# Altium schematic sheet WordClock2.SchDoc (continued)
## Parts (continued)
C240  GRM188R71H104KA93D  [CAPC1608X90X35ML10T15]  (value not drawn)
C241  GRM188R71H104KA93D  [CAPC1608X90X35ML10T15]  (value not drawn)
C242  GRM188R71H104KA93D  [CAPC1608X90X35ML10T15]  (value not drawn)
C243  GRM188R71H104KA93D  [CAPC1608X90X35ML10T15]  (value not drawn)
C244  GRM188R71H104KA93D  [CAPC1608X90X35ML10T15]  (value not drawn)
C245  GRM188R71H104KA93D  [CAPC1608X90X35ML10T15]  (value not drawn)
C246  GRM188R71H104KA93D  [CAPC1608X90X35ML10T15]  (value not drawn)
C247  GRM188R71H104KA93D  [CAPC1608X90X35ML10T15]  (value not drawn)
C248  GRM188R71H104KA93D  [CAPC1608X90X35ML10T15]  (value not drawn)
C249  GRM188R71H104KA93D  [CAPC1608X90X35ML10T15]  (value not drawn)
C250  GRM188R71H104KA93D  [CAPC1608X90X35ML10T15]  (value not drawn)
C251  GRM188R71H104KA93D  [CAPC1608X90X35ML10T15]  (value not drawn)
C252  GRM188R71H104KA93D  [CAPC1608X90X35ML10T15]  (value not drawn)
C253  GRM188R71H104KA93D  [CAPC1608X90X35ML10T15]  (value not drawn)
C254  GRM188R71H104KA93D  [CAPC1608X90X35ML10T15]  (value not drawn)
C255  GRM188R71H104KA93D  [CAPC1608X90X35ML10T15]  (value not drawn)
C256  GRM188R71H104KA93D  [CAPC1608X90X35ML10T15]  (value not drawn)
C257  CL05A226MQ5QUNC  [FP-CL746-IPC_C]
C258  CL05A226MQ5QUNC  [FP-CL746-IPC_C]
E1  1760490000  [PM_5_08_90_02]
J1  USB4110-GF-A  [FP-USB4110-GF-A-MFG]
J2  TC2030-IDC-NL  [TAG_TC2030-IDC-NL]
R1  CRCW060310K0FKEA  [RESC1609X50X30NL8T20]
R2  CRCW06035K10FKEA  [FP-CRCW0603-e3-IPC_C]
R3  CRCW06035K10FKEA  [FP-CRCW0603-e3-IPC_C]
SW1  147873-1  [FP-147873-1-MFG]
U1  1655  [ADA-RGB-1655_V]
U2  1655  [ADA-RGB-1655_V]
U3  1655  [ADA-RGB-1655_V]
U4  1655  [ADA-RGB-1655_V]
U5  1655  [ADA-RGB-1655_V]
U6  1655  [ADA-RGB-1655_V]
U7  1655  [ADA-RGB-1655_V]
U8  1655  [ADA-RGB-1655_V]
U9  1655  [ADA-RGB-1655_V]
U10  1655  [ADA-RGB-1655_V]
U11  1655  [ADA-RGB-1655_V]
U12  1655  [ADA-RGB-1655_V]
U13  1655  [ADA-RGB-1655_V]
U14  1655  [ADA-RGB-1655_V]
U15  1655  [ADA-RGB-1655_V]
U16  1655  [ADA-RGB-1655_V]
U17  1655  [ADA-RGB-1655_V]
U18  1655  [ADA-RGB-1655_V]
U19  1655  [ADA-RGB-1655_V]
U20  1655  [ADA-RGB-1655_V]
U21  1655  [ADA-RGB-1655_V]
U22  1655  [ADA-RGB-1655_V]
U23  1655  [ADA-RGB-1655_V]
U24  1655  [ADA-RGB-1655_V]
U25  1655  [ADA-RGB-1655_V]
U26  1655  [ADA-RGB-1655_V]
U27  1655  [ADA-RGB-1655_V]
U28  1655  [ADA-RGB-1655_V]
U29  1655  [ADA-RGB-1655_V]
U30  1655  [ADA-RGB-1655_V]
U31  1655  [ADA-RGB-1655_V]
U32  1655  [ADA-RGB-1655_V]
U33  1655  [ADA-RGB-1655_V]
U34  1655  [ADA-RGB-1655_V]
U35  1655  [ADA-RGB-1655_V]
U36  1655  [ADA-RGB-1655_V]
U37  1655  [ADA-RGB-1655_V]
U38  1655  [ADA-RGB-1655_V]
U39  1655  [ADA-RGB-1655_V]
U40  1655  [ADA-RGB-1655_V]
U41  1655  [ADA-RGB-1655_V]
U42  1655  [ADA-RGB-1655_V]
U43  1655  [ADA-RGB-1655_V]
U44  1655  [ADA-RGB-1655_V]
U45  1655  [ADA-RGB-1655_V]
U46  1655  [ADA-RGB-1655_V]
U47  1655  [ADA-RGB-1655_V]
U48  1655  [ADA-RGB-1655_V]
U49  1655  [ADA-RGB-1655_V]
U50  1655  [ADA-RGB-1655_V]
U51  1655  [ADA-RGB-1655_V]
U52  1655  [ADA-RGB-1655_V]
U53  1655  [ADA-RGB-1655_V]
U54  1655  [ADA-RGB-1655_V]
U55  1655  [ADA-RGB-1655_V]
U56  1655  [ADA-RGB-1655_V]
U57  1655  [ADA-RGB-1655_V]
U58  1655  [ADA-RGB-1655_V]
U59  1655  [ADA-RGB-1655_V]
U60  1655  [ADA-RGB-1655_V]
U61  1655  [ADA-RGB-1655_V]
U62  1655  [ADA-RGB-1655_V]
U63  1655  [ADA-RGB-1655_V]
U64  1655  [ADA-RGB-1655_V]
U65  1655  [ADA-RGB-1655_V]
U66  1655  [ADA-RGB-1655_V]
U67  1655  [ADA-RGB-1655_V]
U68  1655  [ADA-RGB-1655_V]
U69  1655  [ADA-RGB-1655_V]
U70  1655  [ADA-RGB-1655_V]
U71  1655  [ADA-RGB-1655_V]
U72  1655  [ADA-RGB-1655_V]
U73  1655  [ADA-RGB-1655_V]
U74  1655  [ADA-RGB-1655_V]
U75  1655  [ADA-RGB-1655_V]
U76  1655  [ADA-RGB-1655_V]
U77  1655  [ADA-RGB-1655_V]
U78  1655  [ADA-RGB-1655_V]
U79  1655  [ADA-RGB-1655_V]
U80  1655  [ADA-RGB-1655_V]
U81  1655  [ADA-RGB-1655_V]
U82  1655  [ADA-RGB-1655_V]
U83  1655  [ADA-RGB-1655_V]
U84  1655  [ADA-RGB-1655_V]
U85  1655  [ADA-RGB-1655_V]
U86  1655  [ADA-RGB-1655_V]
U87  1655  [ADA-RGB-1655_V]
U88  1655  [ADA-RGB-1655_V]
U89  1655  [ADA-RGB-1655_V]
U90  1655  [ADA-RGB-1655_V]
U91  1655  [ADA-RGB-1655_V]
U92  1655  [ADA-RGB-1655_V]
U93  1655  [ADA-RGB-1655_V]
U94  1655  [ADA-RGB-1655_V]
U95  1655  [ADA-RGB-1655_V]
U96  1655  [ADA-RGB-1655_V]
U97  1655  [ADA-RGB-1655_V]
U98  1655  [ADA-RGB-1655_V]
U99  1655  [ADA-RGB-1655_V]
U100  1655  [ADA-RGB-1655_V]
U101  1655  [ADA-RGB-1655_V]
U102  1655  [ADA-RGB-1655_V]
U103  1655  [ADA-RGB-1655_V]
U104  1655  [ADA-RGB-1655_V]
U105  1655  [ADA-RGB-1655_V]
U106  1655  [ADA-RGB-1655_V]
U107  1655  [ADA-RGB-1655_V]
U108  1655  [ADA-RGB-1655_V]
U109  1655  [ADA-RGB-1655_V]
U110  1655  [ADA-RGB-1655_V]
U111  1655  [ADA-RGB-1655_V]
U112  1655  [ADA-RGB-1655_V]
U113  1655  [ADA-RGB-1655_V]
U114  1655  [ADA-RGB-1655_V]
U115  1655  [ADA-RGB-1655_V]
U116  1655  [ADA-RGB-1655_V]
U117  1655  [ADA-RGB-1655_V]
U118  1655  [ADA-RGB-1655_V]
U119  1655  [ADA-RGB-1655_V]
U120  1655  [ADA-RGB-1655_V]
U121  1655  [ADA-RGB-1655_V]
U122  1655  [ADA-RGB-1655_V]
U123  1655  [ADA-RGB-1655_V]
U124  1655  [ADA-RGB-1655_V]
U125  1655  [ADA-RGB-1655_V]
U126  1655  [ADA-RGB-1655_V]
U127  1655  [ADA-RGB-1655_V]
U128  1655  [ADA-RGB-1655_V]
U129  1655  [ADA-RGB-1655_V]
U130  1655  [ADA-RGB-1655_V]
U131  1655  [ADA-RGB-1655_V]
U132  1655  [ADA-RGB-1655_V]
U133  1655  [ADA-RGB-1655_V]
U134  1655  [ADA-RGB-1655_V]
U135  1655  [ADA-RGB-1655_V]
U136  1655  [ADA-RGB-1655_V]
U137  1655  [ADA-RGB-1655_V]
U138  1655  [ADA-RGB-1655_V]
U139  1655  [ADA-RGB-1655_V]
U140  1655  [ADA-RGB-1655_V]
U141  1655  [ADA-RGB-1655_V]
U142  1655  [ADA-RGB-1655_V]
U143  1655  [ADA-RGB-1655_V]
U144  1655  [ADA-RGB-1655_V]
U145  1655  [ADA-RGB-1655_V]
U146  1655  [ADA-RGB-1655_V]
U147  1655  [ADA-RGB-1655_V]
U148  1655  [ADA-RGB-1655_V]
U149  1655  [ADA-RGB-1655_V]
U150  1655  [ADA-RGB-1655_V]
U151  1655  [ADA-RGB-1655_V]
U152  1655  [ADA-RGB-1655_V]
U153  1655  [ADA-RGB-1655_V]
U154  1655  [ADA-RGB-1655_V]
U155  1655  [ADA-RGB-1655_V]
U156  1655  [ADA-RGB-1655_V]
U157  1655  [ADA-RGB-1655_V]
U158  1655  [ADA-RGB-1655_V]
U159  1655  [ADA-RGB-1655_V]
U160  1655  [ADA-RGB-1655_V]
U161  1655  [ADA-RGB-1655_V]
U162  1655  [ADA-RGB-1655_V]
U163  1655  [ADA-RGB-1655_V]
U164  1655  [ADA-RGB-1655_V]
U165  1655  [ADA-RGB-1655_V]
U166  1655  [ADA-RGB-1655_V]
U167  1655  [ADA-RGB-1655_V]
U168  1655  [ADA-RGB-1655_V]
U169  1655  [ADA-RGB-1655_V]
U170  1655  [ADA-RGB-1655_V]
U171  1655  [ADA-RGB-1655_V]
U172  1655  [ADA-RGB-1655_V]
U173  1655  [ADA-RGB-1655_V]
U174  1655  [ADA-RGB-1655_V]
U175  1655  [ADA-RGB-1655_V]
U176  1655  [ADA-RGB-1655_V]
U177  1655  [ADA-RGB-1655_V]
U178  1655  [ADA-RGB-1655_V]
U179  1655  [ADA-RGB-1655_V]
U180  1655  [ADA-RGB-1655_V]
U181  1655  [ADA-RGB-1655_V]
U182  1655  [ADA-RGB-1655_V]
U183  1655  [ADA-RGB-1655_V]
U184  1655  [ADA-RGB-1655_V]
U185  1655  [ADA-RGB-1655_V]
U186  1655  [ADA-RGB-1655_V]
U187  1655  [ADA-RGB-1655_V]
U188  1655  [ADA-RGB-1655_V]
U189  1655  [ADA-RGB-1655_V]
U190  1655  [ADA-RGB-1655_V]
U191  1655  [ADA-RGB-1655_V]
U192  1655  [ADA-RGB-1655_V]
U193  1655  [ADA-RGB-1655_V]
U194  1655  [ADA-RGB-1655_V]
U195  1655  [ADA-RGB-1655_V]
U196  1655  [ADA-RGB-1655_V]
U197  1655  [ADA-RGB-1655_V]
U198  1655  [ADA-RGB-1655_V]
U199  1655  [ADA-RGB-1655_V]
U200  1655  [ADA-RGB-1655_V]
U201  1655  [ADA-RGB-1655_V]
U202  1655  [ADA-RGB-1655_V]
U203  1655  [ADA-RGB-1655_V]
U204  1655  [ADA-RGB-1655_V]
U205  1655  [ADA-RGB-1655_V]
U206  1655  [ADA-RGB-1655_V]
U207  1655  [ADA-RGB-1655_V]
U208  1655  [ADA-RGB-1655_V]
U209  1655  [ADA-RGB-1655_V]
U210  1655  [ADA-RGB-1655_V]
U211  1655  [ADA-RGB-1655_V]
U212  1655  [ADA-RGB-1655_V]
U213  1655  [ADA-RGB-1655_V]
U214  1655  [ADA-RGB-1655_V]
U215  1655  [ADA-RGB-1655_V]
U216  1655  [ADA-RGB-1655_V]
U217  1655  [ADA-RGB-1655_V]
U218  1655  [ADA-RGB-1655_V]
U219  1655  [ADA-RGB-1655_V]
U220  1655  [ADA-RGB-1655_V]
U221  1655  [ADA-RGB-1655_V]
U222  1655  [ADA-RGB-1655_V]
U223  1655  [ADA-RGB-1655_V]
U224  1655  [ADA-RGB-1655_V]
U225  1655  [ADA-RGB-1655_V]
U226  1655  [ADA-RGB-1655_V]
U227  1655  [ADA-RGB-1655_V]
U228  1655  [ADA-RGB-1655_V]
U229  1655  [ADA-RGB-1655_V]
U230  1655  [ADA-RGB-1655_V]
U231  1655  [ADA-RGB-1655_V]
U232  1655  [ADA-RGB-1655_V]
U233  1655  [ADA-RGB-1655_V]
U234  1655  [ADA-RGB-1655_V]
U235  1655  [ADA-RGB-1655_V]
U236  1655  [ADA-RGB-1655_V]
U237  1655  [ADA-RGB-1655_V]
U238  1655  [ADA-RGB-1655_V]
U239  1655  [ADA-RGB-1655_V]
U240  1655  [ADA-RGB-1655_V]
U241  1655  [ADA-RGB-1655_V]
U242  1655  [ADA-RGB-1655_V]
U243  1655  [ADA-RGB-1655_V]
U244  1655  [ADA-RGB-1655_V]
U245  1655  [ADA-RGB-1655_V]
U246  1655  [ADA-RGB-1655_V]
U247  1655  [ADA-RGB-1655_V]
U248  1655  [ADA-RGB-1655_V]
U249  1655  [ADA-RGB-1655_V]
U250  1655  [ADA-RGB-1655_V]
U251  1655  [ADA-RGB-1655_V]
U252  1655  [ADA-RGB-1655_V]
U253  1655  [ADA-RGB-1655_V]
U254  1655  [ADA-RGB-1655_V]
U255  1655  [ADA-RGB-1655_V]
U256  1655  [ADA-RGB-1655_V]
U257  ESP32-S3-WROOM-1U  [XCVR_ESP32-S3-WROOM-1U]
U258  LM1117MPX-3.3/NOPB  [DCY0004A_L]

## Ports
TCK (see WordClock2[9B]), TCK (see WordClock2[11B]), TDI (see WordClock2[9B]), TDI (see WordClock2[11B]), TDO (see WordClock2[9B]), TDO (see WordClock2[11B]), TMS (see WordClock2[9B]), TMS (see WordClock2[11B]), WS_DAT (see WordClock2[1A]), WS_DAT (see WordClock2[10B])

## Nets
+5: C1.1 C2.1 C3.1 C4.1 C5.1 C6.1 C7.1 C8.1 C9.1 C10.1 C11.1 C12.1 C13.1 C14.1 C15.1 C16.1 C17.1 C18.1 C19.1 C20.1 C21.1 C22.1 C23.1 C24.1 C25.1 C26.1 C27.1 C28.1 C29.1 C30.1 C31.1 C32.1 C33.1 C34.1 C35.1 C36.1 C37.1 C38.1 C39.1 C40.1 C41.1 C42.1 C43.1 C44.1 C45.1 C46.1 C47.1 C48.1 C49.1 C50.1 C51.1 C52.1 C53.1 C54.1 C55.1 C56.1 C57.1 C58.1 C59.1 C60.1 C61.1 C62.1 C63.1 C64.1 C65.1 C66.1 C67.1 C68.1 C69.1 C70.1 C71.1 C72.1 C73.1 C74.1 C75.1 C76.1 C77.1 C78.1 C79.1 C80.1 C81.1 C82.1 C83.1 C84.1 C85.1 C86.1 C87.1 C88.1 C89.1 C90.1 C91.1 C92.1 C93.1 C94.1 C95.1 C96.1 C97.1 C98.1 C99.1 C100.1 C101.1 C102.1 C103.1 C104.1 C105.1 C106.1 C107.1 C108.1 C109.1 C110.1 C111.1 C112.1 C113.1 C114.1 C115.1 C116.1 C117.1 C118.1 C119.1 C120.1 C121.1 C122.1 C123.1 C124.1 C125.1 C126.1 C127.1 C128.1 C129.1 C130.1 C131.1 C132.1 C133.1 C134.1 C135.1 C136.1 C137.1 C138.1 C139.1 C140.1 C141.1 C142.1 C143.1 C144.1 C145.1 C146.1 C147.1 C148.1 C149.1 C150.1 C151.1 C152.1 C153.1 C154.1 C155.1 C156.1 C157.1 C158.1 C159.1 C160.1 C161.1 C162.1 C163.1 C164.1 C165.1 C166.1 C167.1 C168.1 C169.1 C170.1 C171.1 C172.1 C173.1 C174.1 C175.1 C176.1 C177.1 C178.1 C179.1 C180.1 C181.1 C182.1 C183.1 C184.1 C185.1 C186.1 C187.1 C188.1 C189.1 C190.1 C191.1 C192.1 C193.1 C194.1 C195.1 C196.1 C197.1 C198.1 C199.1 C200.1 C201.1 C202.1 C203.1 C204.1 C205.1 C206.1 C207.1 C208.1 C209.1 C210.1 C211.1 C212.1 C213.1 C214.1 C215.1 C216.1 C217.1 C218.1 C219.1 C220.1 C221.1 C222.1 C223.1 C224.1 C225.1 C226.1 C227.1 C228.1 C229.1 C230.1 C231.1 C232.1 C233.1 C234.1 C235.1 C236.1 C237.1 C238.1 C239.1 C240.1 C241.1 C242.1 C243.1 C244.1 C245.1 C246.1 C247.1 C248.1 C249.1 C250.1 C251.1 C252.1 C253.1 C254.1 C255.1 C256.1 E1.A1 J1.A4-B9(VBUS) J1.B4-A9(VBUS) U1.1(VDD) U2.1(VDD) U3.1(VDD) U4.1(VDD) U5.1(VDD) U6.1(VDD) U7.1(VDD) U8.1(VDD) U9.1(VDD) U10.1(VDD) U11.1(VDD) U12.1(VDD) U13.1(VDD) U14.1(VDD) U15.1(VDD) U16.1(VDD) U17.1(VDD) U18.1(VDD) U19.1(VDD) U20.1(VDD) U21.1(VDD) U22.1(VDD) U23.1(VDD) U24.1(VDD) U25.1(VDD) U26.1(VDD) U27.1(VDD) U28.1(VDD) U29.1(VDD) U30.1(VDD) U31.1(VDD) U32.1(VDD) U33.1(VDD) U34.1(VDD) U35.1(VDD) U36.1(VDD) U37.1(VDD) U38.1(VDD) U39.1(VDD) U40.1(VDD) U41.1(VDD) U42.1(VDD) U43.1(VDD) U44.1(VDD) U45.1(VDD) U46.1(VDD) U47.1(VDD) U48.1(VDD) U49.1(VDD) U50.1(VDD) U51.1(VDD) U52.1(VDD) U53.1(VDD) U54.1(VDD) U55.1(VDD) U56.1(VDD) U57.1(VDD) U58.1(VDD) U59.1(VDD) U60.1(VDD) U61.1(VDD) U62.1(VDD) U63.1(VDD) U64.1(VDD) U65.1(VDD) U66.1(VDD) U67.1(VDD) U68.1(VDD) U69.1(VDD) U70.1(VDD) U71.1(VDD) U72.1(VDD) U73.1(VDD) U74.1(VDD) U75.1(VDD) U76.1(VDD) U77.1(VDD) U78.1(VDD) U79.1(VDD) U80.1(VDD) U81.1(VDD) U82.1(VDD) U83.1(VDD) U84.1(VDD) U85.1(VDD) U86.1(VDD) U87.1(VDD) U88.1(VDD) U89.1(VDD) U90.1(VDD) U91.1(VDD) U92.1(VDD) U93.1(VDD) U94.1(VDD) U95.1(VDD) U96.1(VDD) U97.1(VDD) U98.1(VDD) U99.1(VDD) U100.1(VDD) U101.1(VDD) U102.1(VDD) U103.1(VDD) U104.1(VDD) U105.1(VDD) U106.1(VDD) U107.1(VDD) U108.1(VDD) U109.1(VDD) U110.1(VDD) U111.1(VDD) U112.1(VDD) U113.1(VDD) U114.1(VDD) U115.1(VDD) U116.1(VDD) U117.1(VDD) U118.1(VDD) U119.1(VDD) U120.1(VDD) U121.1(VDD) U122.1(VDD) U123.1(VDD) U124.1(VDD) U125.1(VDD) U126.1(VDD) U127.1(VDD) U128.1(VDD) U129.1(VDD) U130.1(VDD) U131.1(VDD) U132.1(VDD) U133.1(VDD) U134.1(VDD) U135.1(VDD) U136.1(VDD) U137.1(VDD) U138.1(VDD) U139.1(VDD) U140.1(VDD) U141.1(VDD) U142.1(VDD) U143.1(VDD) U144.1(VDD) U145.1(VDD) U146.1(VDD) U147.1(VDD) U148.1(VDD) U149.1(VDD) U150.1(VDD) U151.1(VDD) U152.1(VDD) U153.1(VDD) U154.1(VDD) U155.1(VDD) U156.1(VDD) U157.1(VDD) U158.1(VDD) U159.1(VDD) U160.1(VDD) U161.1(VDD) U162.1(VDD) U163.1(VDD) U164.1(VDD) U165.1(VDD) U166.1(VDD) U167.1(VDD) U168.1(VDD) U169.1(VDD) U170.1(VDD) U171.1(VDD) U172.1(VDD) U173.1(VDD) U174.1(VDD) U175.1(VDD) U176.1(VDD) U177.1(VDD) U178.1(VDD) U179.1(VDD) U180.1(VDD) U181.1(VDD) U182.1(VDD) U183.1(VDD) U184.1(VDD) U185.1(VDD) U186.1(VDD) U187.1(VDD) U188.1(VDD) U189.1(VDD) U190.1(VDD) U191.1(VDD) U192.1(VDD) U193.1(VDD) U194.1(VDD) U195.1(VDD) U196.1(VDD) U197.1(VDD) U198.1(VDD) U199.1(VDD) U200.1(VDD) U201.1(VDD) U202.1(VDD) U203.1(VDD) U204.1(VDD) U205.1(VDD) U206.1(VDD) U207.1(VDD) U208.1(VDD) U209.1(VDD) U210.1(VDD) U211.1(VDD) U212.1(VDD) U213.1(VDD) U214.1(VDD) U215.1(VDD) U216.1(VDD) U217.1(VDD) U218.1(VDD) U219.1(VDD) U220.1(VDD) U221.1(VDD) U222.1(VDD) U223.1(VDD) U224.1(VDD) U225.1(VDD) U226.1(VDD) U227.1(VDD) U228.1(VDD) U229.1(VDD) U230.1(VDD) U231.1(VDD) U232.1(VDD) U233.1(VDD) U234.1(VDD) U235.1(VDD) U236.1(VDD) U237.1(VDD) U238.1(VDD) U239.1(VDD) U240.1(VDD) U241.1(VDD) U242.1(VDD) U243.1(VDD) U244.1(VDD) U245.1(VDD) U246.1(VDD) U247.1(VDD) U248.1(VDD) U249.1(VDD) U250.1(VDD) U251.1(VDD) U252.1(VDD) U253.1(VDD) U254.1(VDD) U255.1(VDD) U256.1(VDD) U258.3(IN)
GND: *1.1 *2.1 *3.1 *4.1 C1.2 C2.2 C3.2 C4.2 C5.2 C6.2 C7.2 C8.2 C9.2 C10.2 C11.2 C12.2 C13.2 C14.2 C15.2 C16.2 C17.2 C18.2 C19.2 C20.2 C21.2 C22.2 C23.2 C24.2 C25.2 C26.2 C27.2 C28.2 C29.2 C30.2 C31.2 C32.2 C33.2 C34.2 C35.2 C36.2 C37.2 C38.2 C39.2 C40.2 C41.2 C42.2 C43.2 C44.2 C45.2 C46.2 C47.2 C48.2 C49.2 C50.2 C51.2 C52.2 C53.2 C54.2 C55.2 C56.2 C57.2 C58.2 C59.2 C60.2 C61.2 C62.2 C63.2 C64.2 C65.2 C66.2 C67.2 C68.2 C69.2 C70.2 C71.2 C72.2 C73.2 C74.2 C75.2 C76.2 C77.2 C78.2 C79.2 C80.2 C81.2 C82.2 C83.2 C84.2 C85.2 C86.2 C87.2 C88.2 C89.2 C90.2 C91.2 C92.2 C93.2 C94.2 C95.2 C96.2 C97.2 C98.2 C99.2 C100.2 C101.2 C102.2 C103.2 C104.2 C105.2 C106.2 C107.2 C108.2 C109.2 C110.2 C111.2 C112.2 C113.2 C114.2 C115.2 C116.2 C117.2 C118.2 C119.2 C120.2 C121.2 C122.2 C123.2 C124.2 C125.2 C126.2 C127.2 C128.2 C129.2 C130.2 C131.2 C132.2 C133.2 C134.2 C135.2 C136.2 C137.2 C138.2 C139.2 C140.2 C141.2 C142.2 C143.2 C144.2 C145.2 C146.2 C147.2 C148.2 C149.2 C150.2 C151.2 C152.2 C153.2 C154.2 C155.2 C156.2 C157.2 C158.2 C159.2 C160.2 C161.2 C162.2 C163.2 C164.2 C165.2 C166.2 C167.2 C168.2 C169.2 C170.2 C171.2 C172.2 C173.2 C174.2 C175.2 C176.2 C177.2 C178.2 C179.2 C180.2 C181.2 C182.2 C183.2 C184.2 C185.2 C186.2 C187.2 C188.2 C189.2 C190.2 C191.2 C192.2 C193.2 C194.2 C195.2 C196.2 C197.2 C198.2 C199.2 C200.2 C201.2 C202.2 C203.2 C204.2 C205.2 C206.2 C207.2 C208.2 C209.2 C210.2 C211.2 C212.2 C213.2 C214.2 C215.2 C216.2 C217.2 C218.2 C219.2 C220.2 C221.2 C222.2 C223.2 C224.2 C225.2 C226.2 C227.2 C228.2 C229.2 C230.2 C231.2 C232.2 C233.2 C234.2 C235.2 C236.2 C237.2 C238.2 C239.2 C240.2 C241.2 C242.2 C243.2 C244.2 C245.2 C246.2 C247.2 C248.2 C249.2 C250.2 C251.2 C252.2 C253.2 C254.2 C255.2 C256.2 C257.2 C258.2 E1.A2 J1.1(MNT_1) J1.2(MNT_2) J1.3(MNT_3) J1.4(MNT_4) J1.A1-B12(GND) J1.B1-A12(GND) J2.5(GND) R2.1 R3.1 SW1.1 U1.3(VSS) U2.3(VSS) U3.3(VSS) U4.3(VSS) U5.3(VSS) U6.3(VSS) U7.3(VSS) U8.3(VSS) U9.3(VSS) U10.3(VSS) U11.3(VSS) U12.3(VSS) U13.3(VSS) U14.3(VSS) U15.3(VSS) U16.3(VSS) U17.3(VSS) U18.3(VSS) U19.3(VSS) U20.3(VSS) U21.3(VSS) U22.3(VSS) U23.3(VSS) U24.3(VSS) U25.3(VSS) U26.3(VSS) U27.3(VSS) U28.3(VSS) U29.3(VSS) U30.3(VSS) U31.3(VSS) U32.3(VSS) U33.3(VSS) U34.3(VSS) U35.3(VSS) U36.3(VSS) U37.3(VSS) U38.3(VSS) U39.3(VSS) U40.3(VSS) U41.3(VSS) U42.3(VSS) U43.3(VSS) U44.3(VSS) U45.3(VSS) U46.3(VSS) U47.3(VSS) U48.3(VSS) U49.3(VSS) U50.3(VSS) U51.3(VSS) U52.3(VSS) U53.3(VSS) U54.3(VSS) U55.3(VSS) U56.3(VSS) U57.3(VSS) U58.3(VSS) U59.3(VSS) U60.3(VSS) U61.3(VSS) U62.3(VSS) U63.3(VSS) U64.3(VSS) U65.3(VSS) U66.3(VSS) U67.3(VSS) U68.3(VSS) U69.3(VSS) U70.3(VSS) U71.3(VSS) U72.3(VSS) U73.3(VSS) U74.3(VSS) U75.3(VSS) U76.3(VSS) U77.3(VSS) U78.3(VSS) U79.3(VSS) U80.3(VSS) U81.3(VSS) U82.3(VSS) U83.3(VSS) U84.3(VSS) U85.3(VSS) U86.3(VSS) U87.3(VSS) U88.3(VSS) U89.3(VSS) U90.3(VSS) U91.3(VSS) U92.3(VSS) U93.3(VSS) U94.3(VSS) U95.3(VSS) U96.3(VSS) U97.3(VSS) U98.3(VSS) U99.3(VSS) U100.3(VSS) U101.3(VSS) U102.3(VSS) U103.3(VSS) U104.3(VSS) U105.3(VSS) U106.3(VSS) U107.3(VSS) U108.3(VSS) U109.3(VSS) U110.3(VSS) U111.3(VSS) U112.3(VSS) U113.3(VSS) U114.3(VSS) U115.3(VSS) U116.3(VSS) U117.3(VSS) U118.3(VSS) U119.3(VSS) U120.3(VSS) U121.3(VSS) U122.3(VSS) U123.3(VSS) U124.3(VSS) U125.3(VSS) U126.3(VSS) U127.3(VSS) U128.3(VSS) U129.3(VSS) U130.3(VSS) U131.3(VSS) U132.3(VSS) U133.3(VSS) U134.3(VSS) U135.3(VSS) U136.3(VSS) U137.3(VSS) U138.3(VSS) U139.3(VSS) U140.3(VSS) U141.3(VSS) U142.3(VSS) U143.3(VSS) U144.3(VSS) U145.3(VSS) U146.3(VSS) U147.3(VSS) U148.3(VSS) U149.3(VSS) U150.3(VSS) U151.3(VSS) U152.3(VSS) U153.3(VSS) U154.3(VSS) U155.3(VSS) U156.3(VSS) U157.3(VSS) U158.3(VSS) U159.3(VSS) U160.3(VSS) U161.3(VSS) U162.3(VSS) U163.3(VSS) U164.3(VSS) U165.3(VSS) U166.3(VSS) U167.3(VSS) U168.3(VSS) U169.3(VSS) U170.3(VSS) U171.3(VSS) U172.3(VSS) U173.3(VSS) U174.3(VSS) U175.3(VSS) U176.3(VSS) U177.3(VSS) U178.3(VSS) U179.3(VSS) U180.3(VSS) U181.3(VSS) U182.3(VSS) U183.3(VSS) U184.3(VSS) U185.3(VSS) U186.3(VSS) U187.3(VSS) U188.3(VSS) U189.3(VSS) U190.3(VSS) U191.3(VSS) U192.3(VSS) U193.3(VSS) U194.3(VSS) U195.3(VSS) U196.3(VSS) U197.3(VSS) U198.3(VSS) U199.3(VSS) U200.3(VSS) U201.3(VSS) U202.3(VSS) U203.3(VSS) U204.3(VSS) U205.3(VSS) U206.3(VSS) U207.3(VSS) U208.3(VSS) U209.3(VSS) U210.3(VSS) U211.3(VSS) U212.3(VSS) U213.3(VSS) U214.3(VSS) U215.3(VSS) U216.3(VSS) U217.3(VSS) U218.3(VSS) U219.3(VSS) U220.3(VSS) U221.3(VSS) U222.3(VSS) U223.3(VSS) U224.3(VSS) U225.3(VSS) U226.3(VSS) U227.3(VSS) U228.3(VSS) U229.3(VSS) U230.3(VSS) U231.3(VSS) U232.3(VSS) U233.3(VSS) U234.3(VSS) U235.3(VSS) U236.3(VSS) U237.3(VSS) U238.3(VSS) U239.3(VSS) U240.3(VSS) U241.3(VSS) U242.3(VSS) U243.3(VSS) U244.3(VSS) U245.3(VSS) U246.3(VSS) U247.3(VSS) U248.3(VSS) U249.3(VSS) U250.3(VSS) U251.3(VSS) U252.3(VSS) U253.3(VSS) U254.3(VSS) U255.3(VSS) U256.3(VSS) U257.1(GND) U257.40(GND) U257.41_1(GND) U257.41_2(GND) U257.41_3(GND) U257.41_4(GND) U257.41_5(GND) U257.41_6(GND) U257.41_7(GND) U257.41_8(GND) U257.41_9(GND) U258.1(GND)
VCC: C257.1 C258.1 R1.1 U257.2(3V3) U258.2(OUT) U258.4(TAB)
CC1: J1.A5(CC1) R2.2
CC2: J1.B5(CC2) R3.2
TCK: J2.4(SWCLK/TCK) U257.32(IO39) ; port TCK
TDI: J2.1(VCC/TDI) U257.34(IO41) ; port TDI
TDO: J2.6(SWO/TDO) U257.33(IO40) ; port TDO
TMS: J2.2(SWDIO/TMS) U257.35(IO42) ; port TMS
USB_N: J1.A7(Dn1) J1.B7(Dn2) U257.13(IO19)
USB_P: J1.A6(Dp1) J1.B6(Dp2) U257.14(IO20)
WS_DAT: U1.4(DIN) U257.4(IO4) ; port WS_DAT
NetJ2_3: J2.3(nRST) R1.2 SW1.2 U257.3(EN)
NetU1_2: U1.2(DOUT) U2.4(DIN)
NetU2_2: U2.2(DOUT) U3.4(DIN)
NetU3_2: U3.2(DOUT) U4.4(DIN)
NetU4_2: U4.2(DOUT) U5.4(DIN)
NetU5_2: U5.2(DOUT) U6.4(DIN)
NetU6_2: U6.2(DOUT) U7.4(DIN)
NetU7_2: U7.2(DOUT) U8.4(DIN)
NetU8_2: U8.2(DOUT) U9.4(DIN)
NetU9_2: U9.2(DOUT) U10.4(DIN)
NetU10_2: U10.2(DOUT) U11.4(DIN)
NetU11_2: U11.2(DOUT) U12.4(DIN)
NetU12_2: U12.2(DOUT) U13.4(DIN)
NetU13_2: U13.2(DOUT) U14.4(DIN)
NetU14_2: U14.2(DOUT) U15.4(DIN)
NetU15_2: U15.2(DOUT) U16.4(DIN)
NetU16_2: U16.2(DOUT) U17.4(DIN)
NetU17_2: U17.2(DOUT) U18.4(DIN)
NetU18_2: U18.2(DOUT) U19.4(DIN)
NetU19_2: U19.2(DOUT) U20.4(DIN)
NetU20_2: U20.2(DOUT) U21.4(DIN)
NetU21_2: U21.2(DOUT) U22.4(DIN)
NetU22_2: U22.2(DOUT) U23.4(DIN)
NetU23_2: U23.2(DOUT) U24.4(DIN)
NetU24_2: U24.2(DOUT) U25.4(DIN)
NetU25_2: U25.2(DOUT) U26.4(DIN)
NetU26_2: U26.2(DOUT) U27.4(DIN)
NetU27_2: U27.2(DOUT) U28.4(DIN)
NetU28_2: U28.2(DOUT) U29.4(DIN)
NetU29_2: U29.2(DOUT) U30.4(DIN)
NetU30_2: U30.2(DOUT) U31.4(DIN)
NetU31_2: U31.2(DOUT) U32.4(DIN)
NetU32_2: U32.2(DOUT) U33.4(DIN)
NetU33_2: U33.2(DOUT) U34.4(DIN)
NetU34_2: U34.2(DOUT) U35.4(DIN)
NetU35_2: U35.2(DOUT) U36.4(DIN)
NetU36_2: U36.2(DOUT) U37.4(DIN)
NetU37_2: U37.2(DOUT) U38.4(DIN)
NetU38_2: U38.2(DOUT) U39.4(DIN)
NetU39_2: U39.2(DOUT) U40.4(DIN)
NetU40_2: U40.2(DOUT) U41.4(DIN)
NetU41_2: U41.2(DOUT) U42.4(DIN)
NetU42_2: U42.2(DOUT) U43.4(DIN)
NetU43_2: U43.2(DOUT) U44.4(DIN)
NetU44_2: U44.2(DOUT) U45.4(DIN)
NetU45_2: U45.2(DOUT) U46.4(DIN)
NetU46_2: U46.2(DOUT) U47.4(DIN)
NetU47_2: U47.2(DOUT) U48.4(DIN)
NetU48_2: U48.2(DOUT) U49.4(DIN)
NetU49_2: U49.2(DOUT) U50.4(DIN)
NetU50_2: U50.2(DOUT) U51.4(DIN)
NetU51_2: U51.2(DOUT) U52.4(DIN)
NetU52_2: U52.2(DOUT) U53.4(DIN)
NetU53_2: U53.2(DOUT) U54.4(DIN)
NetU54_2: U54.2(DOUT) U55.4(DIN)
NetU55_2: U55.2(DOUT) U56.4(DIN)
NetU56_2: U56.2(DOUT) U57.4(DIN)
NetU57_2: U57.2(DOUT) U58.4(DIN)
NetU58_2: U58.2(DOUT) U59.4(DIN)
NetU59_2: U59.2(DOUT) U60.4(DIN)
NetU60_2: U60.2(DOUT) U61.4(DIN)
NetU61_2: U61.2(DOUT) U62.4(DIN)
NetU62_2: U62.2(DOUT) U63.4(DIN)
NetU63_2: U63.2(DOUT) U64.4(DIN)
NetU64_2: U64.2(DOUT) U65.4(DIN)
NetU65_2: U65.2(DOUT) U66.4(DIN)
NetU66_2: U66.2(DOUT) U67.4(DIN)
NetU67_2: U67.2(DOUT) U68.4(DIN)
NetU68_2: U68.2(DOUT) U69.4(DIN)
NetU69_2: U69.2(DOUT) U70.4(DIN)
NetU70_2: U70.2(DOUT) U71.4(DIN)
NetU71_2: U71.2(DOUT) U72.4(DIN)
NetU72_2: U72.2(DOUT) U73.4(DIN)
NetU73_2: U73.2(DOUT) U74.4(DIN)
NetU74_2: U74.2(DOUT) U75.4(DIN)
NetU75_2: U75.2(DOUT) U76.4(DIN)
NetU76_2: U76.2(DOUT) U77.4(DIN)
NetU77_2: U77.2(DOUT) U78.4(DIN)
NetU78_2: U78.2(DOUT) U79.4(DIN)
NetU79_2: U79.2(DOUT) U80.4(DIN)
NetU80_2: U80.2(DOUT) U81.4(DIN)
NetU81_2: U81.2(DOUT) U82.4(DIN)
NetU82_2: U82.2(DOUT) U83.4(DIN)
NetU83_2: U83.2(DOUT) U84.4(DIN)
NetU84_2: U84.2(DOUT) U85.4(DIN)
NetU85_2: U85.2(DOUT) U86.4(DIN)
NetU86_2: U86.2(DOUT) U87.4(DIN)
NetU87_2: U87.2(DOUT) U88.4(DIN)
NetU88_2: U88.2(DOUT) U89.4(DIN)
NetU89_2: U89.2(DOUT) U90.4(DIN)
NetU90_2: U90.2(DOUT) U91.4(DIN)
NetU91_2: U91.2(DOUT) U92.4(DIN)
NetU92_2: U92.2(DOUT) U93.4(DIN)
NetU93_2: U93.2(DOUT) U94.4(DIN)
NetU94_2: U94.2(DOUT) U95.4(DIN)
NetU95_2: U95.2(DOUT) U96.4(DIN)
NetU96_2: U96.2(DOUT) U97.4(DIN)
NetU97_2: U97.2(DOUT) U98.4(DIN)
NetU98_2: U98.2(DOUT) U99.4(DIN)
NetU99_2: U99.2(DOUT) U100.4(DIN)
NetU100_2: U100.2(DOUT) U101.4(DIN)
NetU101_2: U101.2(DOUT) U102.4(DIN)
NetU102_2: U102.2(DOUT) U103.4(DIN)
NetU103_2: U103.2(DOUT) U104.4(DIN)
NetU104_2: U104.2(DOUT) U105.4(DIN)
NetU105_2: U105.2(DOUT) U106.4(DIN)
NetU106_2: U106.2(DOUT) U107.4(DIN)
NetU107_2: U107.2(DOUT) U108.4(DIN)
NetU108_2: U108.2(DOUT) U109.4(DIN)
NetU109_2: U109.2(DOUT) U110.4(DIN)
NetU110_2: U110.2(DOUT) U111.4(DIN)
NetU111_2: U111.2(DOUT) U112.4(DIN)
NetU112_2: U112.2(DOUT) U113.4(DIN)
NetU113_2: U113.2(DOUT) U114.4(DIN)
NetU114_2: U114.2(DOUT) U115.4(DIN)
NetU115_2: U115.2(DOUT) U116.4(DIN)
NetU116_2: U116.2(DOUT) U117.4(DIN)
NetU117_2: U117.2(DOUT) U118.4(DIN)
NetU118_2: U118.2(DOUT) U119.4(DIN)
NetU119_2: U119.2(DOUT) U120.4(DIN)
NetU120_2: U120.2(DOUT) U121.4(DIN)
NetU121_2: U121.2(DOUT) U122.4(DIN)
NetU122_2: U122.2(DOUT) U123.4(DIN)
NetU123_2: U123.2(DOUT) U124.4(DIN)
NetU124_2: U124.2(DOUT) U125.4(DIN)
NetU125_2: U125.2(DOUT) U126.4(DIN)
NetU126_2: U126.2(DOUT) U127.4(DIN)
NetU127_2: U127.2(DOUT) U128.4(DIN)
NetU128_2: U128.2(DOUT) U129.4(DIN)
NetU129_2: U129.2(DOUT) U130.4(DIN)
NetU130_2: U130.2(DOUT) U131.4(DIN)
NetU131_2: U131.2(DOUT) U132.4(DIN)
NetU132_2: U132.2(DOUT) U133.4(DIN)
NetU133_2: U133.2(DOUT) U134.4(DIN)
NetU134_2: U134.2(DOUT) U135.4(DIN)
NetU135_2: U135.2(DOUT) U136.4(DIN)
NetU136_2: U136.2(DOUT) U137.4(DIN)
NetU137_2: U137.2(DOUT) U138.4(DIN)
NetU138_2: U138.2(DOUT) U139.4(DIN)
NetU139_2: U139.2(DOUT) U140.4(DIN)
NetU140_2: U140.2(DOUT) U141.4(DIN)
NetU141_2: U141.2(DOUT) U142.4(DIN)
NetU142_2: U142.2(DOUT) U143.4(DIN)
NetU143_2: U143.2(DOUT) U144.4(DIN)
NetU144_2: U144.2(DOUT) U145.4(DIN)
NetU145_2: U145.2(DOUT) U146.4(DIN)
NetU146_2: U146.2(DOUT) U147.4(DIN)
NetU147_2: U147.2(DOUT) U148.4(DIN)
NetU148_2: U148.2(DOUT) U149.4(DIN)
NetU149_2: U149.2(DOUT) U150.4(DIN)
NetU150_2: U150.2(DOUT) U151.4(DIN)
NetU151_2: U151.2(DOUT) U152.4(DIN)
NetU152_2: U152.2(DOUT) U153.4(DIN)
NetU153_2: U153.2(DOUT) U154.4(DIN)
NetU154_2: U154.2(DOUT) U155.4(DIN)
NetU155_2: U155.2(DOUT) U156.4(DIN)
NetU156_2: U156.2(DOUT) U157.4(DIN)
NetU157_2: U157.2(DOUT) U158.4(DIN)
NetU158_2: U158.2(DOUT) U159.4(DIN)
NetU159_2: U159.2(DOUT) U160.4(DIN)
NetU160_2: U160.2(DOUT) U161.4(DIN)
NetU161_2: U161.2(DOUT) U162.4(DIN)
NetU162_2: U162.2(DOUT) U163.4(DIN)
NetU163_2: U163.2(DOUT) U164.4(DIN)
NetU164_2: U164.2(DOUT) U165.4(DIN)
NetU165_2: U165.2(DOUT) U166.4(DIN)
NetU166_2: U166.2(DOUT) U167.4(DIN)
NetU167_2: U167.2(DOUT) U168.4(DIN)
NetU168_2: U168.2(DOUT) U169.4(DIN)
NetU169_2: U169.2(DOUT) U170.4(DIN)
NetU170_2: U170.2(DOUT) U171.4(DIN)
NetU171_2: U171.2(DOUT) U172.4(DIN)
NetU172_2: U172.2(DOUT) U173.4(DIN)
NetU173_2: U173.2(DOUT) U174.4(DIN)
NetU174_2: U174.2(DOUT) U175.4(DIN)
NetU175_2: U175.2(DOUT) U176.4(DIN)
NetU176_2: U176.2(DOUT) U177.4(DIN)
NetU177_2: U177.2(DOUT) U178.4(DIN)
NetU178_2: U178.2(DOUT) U179.4(DIN)
NetU179_2: U179.2(DOUT) U180.4(DIN)
NetU180_2: U180.2(DOUT) U181.4(DIN)
NetU181_2: U181.2(DOUT) U182.4(DIN)
NetU182_2: U182.2(DOUT) U183.4(DIN)
NetU183_2: U183.2(DOUT) U184.4(DIN)
NetU184_2: U184.2(DOUT) U185.4(DIN)
NetU185_2: U185.2(DOUT) U186.4(DIN)
NetU186_2: U186.2(DOUT) U187.4(DIN)
NetU187_2: U187.2(DOUT) U188.4(DIN)
NetU188_2: U188.2(DOUT) U189.4(DIN)
NetU189_2: U189.2(DOUT) U190.4(DIN)
NetU190_2: U190.2(DOUT) U191.4(DIN)
NetU191_2: U191.2(DOUT) U192.4(DIN)
NetU192_2: U192.2(DOUT) U193.4(DIN)
NetU193_2: U193.2(DOUT) U194.4(DIN)
NetU194_2: U194.2(DOUT) U195.4(DIN)
NetU195_2: U195.2(DOUT) U196.4(DIN)
NetU196_2: U196.2(DOUT) U197.4(DIN)
NetU197_2: U197.2(DOUT) U198.4(DIN)
NetU198_2: U198.2(DOUT) U199.4(DIN)
NetU199_2: U199.2(DOUT) U200.4(DIN)
NetU200_2: U200.2(DOUT) U201.4(DIN)
NetU201_2: U201.2(DOUT) U202.4(DIN)
NetU202_2: U202.2(DOUT) U203.4(DIN)
NetU203_2: U203.2(DOUT) U204.4(DIN)
NetU204_2: U204.2(DOUT) U205.4(DIN)
NetU205_2: U205.2(DOUT) U206.4(DIN)
NetU206_2: U206.2(DOUT) U207.4(DIN)
NetU207_2: U207.2(DOUT) U208.4(DIN)
NetU208_2: U208.2(DOUT) U209.4(DIN)
NetU209_2: U209.2(DOUT) U210.4(DIN)
NetU210_2: U210.2(DOUT) U211.4(DIN)
NetU211_2: U211.2(DOUT) U212.4(DIN)
NetU212_2: U212.2(DOUT) U213.4(DIN)
NetU213_2: U213.2(DOUT) U214.4(DIN)
NetU214_2: U214.2(DOUT) U215.4(DIN)
NetU215_2: U215.2(DOUT) U216.4(DIN)
NetU216_2: U216.2(DOUT) U217.4(DIN)
NetU217_2: U217.2(DOUT) U218.4(DIN)
NetU218_2: U218.2(DOUT) U219.4(DIN)
NetU219_2: U219.2(DOUT) U220.4(DIN)
NetU220_2: U220.2(DOUT) U221.4(DIN)
NetU221_2: U221.2(DOUT) U222.4(DIN)
NetU222_2: U222.2(DOUT) U223.4(DIN)
NetU223_2: U223.2(DOUT) U224.4(DIN)
NetU224_2: U224.2(DOUT) U225.4(DIN)
NetU225_2: U225.2(DOUT) U226.4(DIN)
NetU226_2: U226.2(DOUT) U227.4(DIN)
NetU227_2: U227.2(DOUT) U228.4(DIN)
NetU228_2: U228.2(DOUT) U229.4(DIN)
NetU229_2: U229.2(DOUT) U230.4(DIN)
NetU230_2: U230.2(DOUT) U231.4(DIN)
NetU231_2: U231.2(DOUT) U232.4(DIN)
NetU232_2: U232.2(DOUT) U233.4(DIN)
NetU233_2: U233.2(DOUT) U234.4(DIN)
NetU234_2: U234.2(DOUT) U235.4(DIN)
NetU235_2: U235.2(DOUT) U236.4(DIN)
NetU236_2: U236.2(DOUT) U237.4(DIN)
NetU237_2: U237.2(DOUT) U238.4(DIN)
NetU238_2: U238.2(DOUT) U239.4(DIN)
NetU239_2: U239.2(DOUT) U240.4(DIN)
NetU240_2: U240.2(DOUT) U241.4(DIN)
NetU241_2: U241.2(DOUT) U242.4(DIN)
NetU242_2: U242.2(DOUT) U243.4(DIN)
NetU243_2: U243.2(DOUT) U244.4(DIN)
NetU244_2: U244.2(DOUT) U245.4(DIN)
NetU245_2: U245.2(DOUT) U246.4(DIN)
NetU246_2: U246.2(DOUT) U247.4(DIN)
NetU247_2: U247.2(DOUT) U248.4(DIN)
NetU248_2: U248.2(DOUT) U249.4(DIN)
NetU249_2: U249.2(DOUT) U250.4(DIN)
NetU250_2: U250.2(DOUT) U251.4(DIN)
NetU251_2: U251.2(DOUT) U252.4(DIN)
NetU252_2: U252.2(DOUT) U253.4(DIN)
NetU253_2: U253.2(DOUT) U254.4(DIN)
NetU254_2: U254.2(DOUT) U255.4(DIN)
NetU255_2: U255.2(DOUT) U256.4(DIN)

Not connected (* = marked no-connect by the designer): J1 A8(SBU1) B8(SBU2); U256 2(DOUT); U257 5(IO5) 6(IO6) 7(IO7) 8(IO15) 9(IO16) 10(IO17) 11(IO18) 12(IO8) 15(IO3) 16(IO46) 17(IO9) 18(IO10) 19(IO11) 20(IO12) 21(IO13) 22(IO14) 23(IO21) 24(IO47) 25(IO48) 26(IO45) 27(IO0) 28(IO35) 29(IO36) 30(IO37) 31(IO38) 36(RXD0) 37(TXD0) 38(IO2) 39(IO1)

## Layout directives
differential pair: USB_N, USB_P

## Notes on the sheet
- Labels drawn without touching a wire or pin: EN

## Library data of the parts
*1-*4 = CMP-010-00024-1: Plated Thru-Hole M3 D5X5; Pins: 1; Mounting Technology: TH
C1-C256 = CMP-2100-03643-1: Chip Capacitor, 0.1 uF, +/- 10%, 50 V, -55 to 125 degC, 0603 (1608 Metric), RoHS, Tape and Reel; Manufacturer: Murata; Dielectric Material: Ceramic; Voltage Rating: 50V; Capacitance: 100nF; Dielectric: X7R; Insulation Resistance: 10GR; Case Code (Metric): 1608; Lead Free: LeadFree; Depth: 0.8mm; Number of Pins: 2; Radiation Hardening: No; Case/Package: 0603; Manufacturer URL: http://www.murata.com/; Packaging: TapeandReel; Length: 1.6mm; Contact Plating: Tin; Datasheet URL: http://psearch.en.murata.com/capacitor/product/GRM188R71H104KA93%23.pdf; Tolerance: 10%; Case Code (Imperial): 0603; Min Operating Temperature: -55degC; RoHSCompliant: true; Voltage: 50V; Termination: SMD/SMT; Mount: SurfaceMount; Material: Ceramic; Package Quantity: 1; Height: 0.8mm; Thickness: 0.035inch; REACH SVHC: NoSVHC; Max Operating Temperature: 125degC; Width: 0.8mm; Package Reference: 0603; Voltage Rating (DC): 50V; Datasheet Version: 42675.0; Package Description: 2-Pin Surface Mount Device, Body 1.6 x 0.8 mm
C257 C258 = CMP-13271-000286-1: Cap Ceramic 22uF 6.3V X5R ±20% SMD 0402 +85°C Paper T/R; Case Code (Imperial): 0402; Tolerance: 20%; Width: 0.02inch; Packaging: Tape and Reel; Case/Package: 0402; Min Operating Temperature: -55°C; Max Operating Temperature: 85°C; Voltage Rating: 6.3V; Capacitance: 22uF; Thickness: 0.022inch; Mount: Surface Mount; Length: 0.039inch; Case Code (Metric): 1005
E1 = CMP-1559-01627-1: OMNIMATE Signal - series PM; Manufacturer: Weidmueller; Contact_surface: tinned; Pitch_mm: 5,08 mm; Solid_min_H05_07_V_U: 0,13 mm²; Wire_cross_section_AWG_min_UL_1059: AWG 26; Wire_cross_section_AWG_max_UL_1059: AWG 14; Rated_voltage_for_surge_voltage_class_pollution_degree_II_2: 600 V; Rated_current_use_group_B_UL_1059: 15 A; Mounting_onto_the_PCB: Solder connection; Solder_pin_length_mm: 3,5 mm; Side_termination_characteristic: closed side; Contact_material: Cu-Leg; Pitch_inch: 0,2 inch; No_of_poles: 2; UL_94_flammability_rating: V-0; Insulating_material: Wemid (PA); Rated_voltage_use_group_B_UL_1059: 300 V; Solid_max_H05_07_V_U: 2,5 mm²; Short_text_for_material: PM 5.08/02/90 3.5SN OR BX; Revision: V1; PartNumber: 1760490000; Qty: 500 PCS; ComponentLink2Description: URL Link1; Packaging: Box; PackageReference: PM_5_08_90_02; ComponentLink2URL: http://catalog.weidmueller.com/catalog/Start.do?localeId=en&ObjectID=1760490000; Colour: Orange; ComponentLink1Description: Manufacturer URL; ComponentLink1URL: http://www.weidmueller.com/
J1 = CMP-245163-000002-1: CONN USB 2.0 TYPE-C R/A SMT; Manufacturer: GCT; Conn Orientation: Right Angle; Usb Standard: USB 2.0; Voltage Rating: 20V; Current Rating: 3/4.25/1.25/0.25A; Number Of Contacts: 16; Is Female: yes; Shielding: true; Standoff Height: 0.1mm; Octopart: https://octopart.com/usb4110-gf-a-gct-103941985; Temperature: -40°C to +85°C; RoHS: TRUE; Automotive: No; Contact Material: Gold,Nickel; Device Class L1: Connectors; Device Class L2: USB Connectors; Package: 0; Lead Free: Yes; ComponentLink2URL: https://gct.co/files/drawings/usb4110.pdf; Temperature Range High: +85°C; Temperature Range Low: -40°C; Height: 3.46mm; Manufacturer Part Number: USB4110-GF-A; ComponentLink2Description: Datasheet; Device Class L3: unset; Digikey Description: CONN USB 2.0 TYPE-C R/A SMT; Category: Conn
J2 = CMP-070-000001-2: CABLE ADAPTER 6 POS; Package: None; Price: None; Pin Count: 6; Component Type: Standard; Availability: Unavailable; MP: TC2030-IDC-NL; Design Item ID: TC2030-IDC-NL; Value: *; Source: TC2030-IDC-NL.SchLib
R1 = CMP-1666-00005-4: Chip Resistor, 10 KOhm, +/- 1%, 100 mW, -55 to 155 degC, 0603 (1608 Metric), RoHS, Tape and Reel; Manufacturer: Vishay Semiconductor; Voltage Rating: 75 V; Max Operating Temperature: 155 degC; PackageDescription: 2-Pin Surface Mount Device, Body 1.575 x 0.85 mm; ComponentLink1Description: Manufacturer URL; RoHSCompliant: true; PackageReference: 0603; REACH SVHC: Unknown; Length: 1.55 mm; DatasheetVersion: 06/2012; Packaging: Tape and Reel; Min Operating Temperature: -55 degC; Mounting Technology: Surface Mount; ComponentLink2URL: https://datasheet.ciiva.com/11809/0900766b80d98afc-11809037.pdf; Height: 0.45 mm; ComponentLink2Description: Datasheet; Package Quantity: 5000; ComponentLink1URL: http://www.vishay.com/
R2 R3 = CMP-1012-00590-3: RES Thick Film, 5.1kΩ, 1%, 0.1W, 100ppm/°C, 0603; Power Rating: 100mW; Voltage Rating (DC): 75V; Resistance: 5.1kR; Width: 0.85mm; Depth: 0.85mm; Military Standard: Not; Package Quantity: 5000; Case Code (Metric): 1608; Length: 1.55mm; Weight: 7.1E-05oz; Packaging: Tape and Reel; Temperature Coefficient: 100ppm/°C; Case Code (Imperial): 0603; Lead Free: Lead Free; Radiation Hardening: No; Contact Plating: Tin; Composition: Thick Film; Max Operating Temperature: 155°C; Termination: SMD/SMT; Case/Package: 0603; Min Operating Temperature: -55°C; Tolerance: 1%; Voltage Rating: 75V; Mount: Surface Mount; Height: 0.45mm
SW1 = CMP-03407-000005-1: SWITCH TACTILE SPST-NO 0.05A 24V; Manufacturer: TE Connectivity; Contact Resistance: 100mΩ; Operating Force: 180gf; Electromechanical Life: 40000Cycles; Contact Current Rating: 50mA; Throw Configuration: SPST-NO; Mouser Description: Switch Tactile OFF (ON) SPST Rectangular Button J-Bend 0.05A 24VDC 1.77N SMD T/R; Mount: Surface Mount; Height: 5.5mm; Category: Switch; RoHS: TRUE; Temperature Range High: +85°C; ComponentLink2Description: Datasheet; Temperature Range Low: -35°C; Device Class L1: Electromechanical; Device Class L2: Switches; Package: 0; Temperature: -35°C to +85°C; Device Class L3: Tactile Switches; Automotive: No; Manufacturer Part Number: 147873-1; ComponentLink2URL: https://www.te.com/commerce/DocumentDelivery/DDEController?Action=showdoc&DocId=Customer+Drawing%7F147873%7FK3%7Fpdf%7FEnglish%7FENG_CD_147873_K3.pdf%7F147873-1; Lead Free: Yes; Voltage Rating Dc: 24V; Octopart: https://octopart.com/147873-1-te+connectivity-40818451; Digikey Description: SWITCH TACTILE SPST-NO 0.05A 24V
U1-U256 = CMP-2000-05026-1: Intelligent Control LED Integrated Light Source, 3.5 to 5.3 V, -25 to 80 degC, 4-Pin SMD, RoHS, Tape and Reel; Manufacturer: Adafruit-Industries-LLC; Number of LEDs: 10; Configuration: Discrete; Utilized LED: WS2812(5050); Datasheet URL: http://datasheet.octopart.com/ADA1655-Adafruit-Industries-datasheet-32028139.pdf; Series: Neopixel; Interface: -; Package Description: 4-Pin Surface Mount Device, Body 5 x 5 mm; Color: Red,Green,Blue(RGB); Category: Optoelectronics; Controller Type: -; Package Reference: 1655; Manufacturer URL: https://www.adafruit.com/; Mounting Type: SurfaceMount; Datasheet Version: May-13; Size / Dimension: 5.00mmLx5.00mmW; Family: Addressable,Specialty
U257 = ESP32-S3-WROOM-1U: 2.4 GHz Wi-Fi (802.11 b/g/n) and Bluetooth 5 (LE) module; MF: {'manufacturer': u'Espressif Systems'}; Package: None; Price: None; Value: *; MP: ESP32-S3-WROOM-1U; Availability: Unavailable
U258 = CMP-0062-01639-4: 800mA Low-Dropout Linear Regulator, 4-pin SOT-223, Pb-Free; Manufacturer: Texas Instruments; High-Reliability: Y; PowerWise: N; PackageTopMarking: XYTT*N05A; CompType: LDO IC; ComponentLink1URL: http://www.ti.com/general/docs/lit/getliterature.tsp?genericPartNumber=LM1117-N&fileType=pdf; PartNumber: LM1117MPX-3.3/NOPB; ComponentLink1Description: Datasheet URL; PinCount: 4; Code_JEDEC: TO-261-AA; PackageDescription: Molded SOT-223, 6.50 x 3.56 x 1.6mm Body, 4 Lead, 2.3mm Pitch; PackageReference: DCY0004A; RoHS: Y; Code_IPC: SOT223-4